# EasyEDA Pro project kuafu01_030内部老化方案.eprj, board PCB4 (continued)
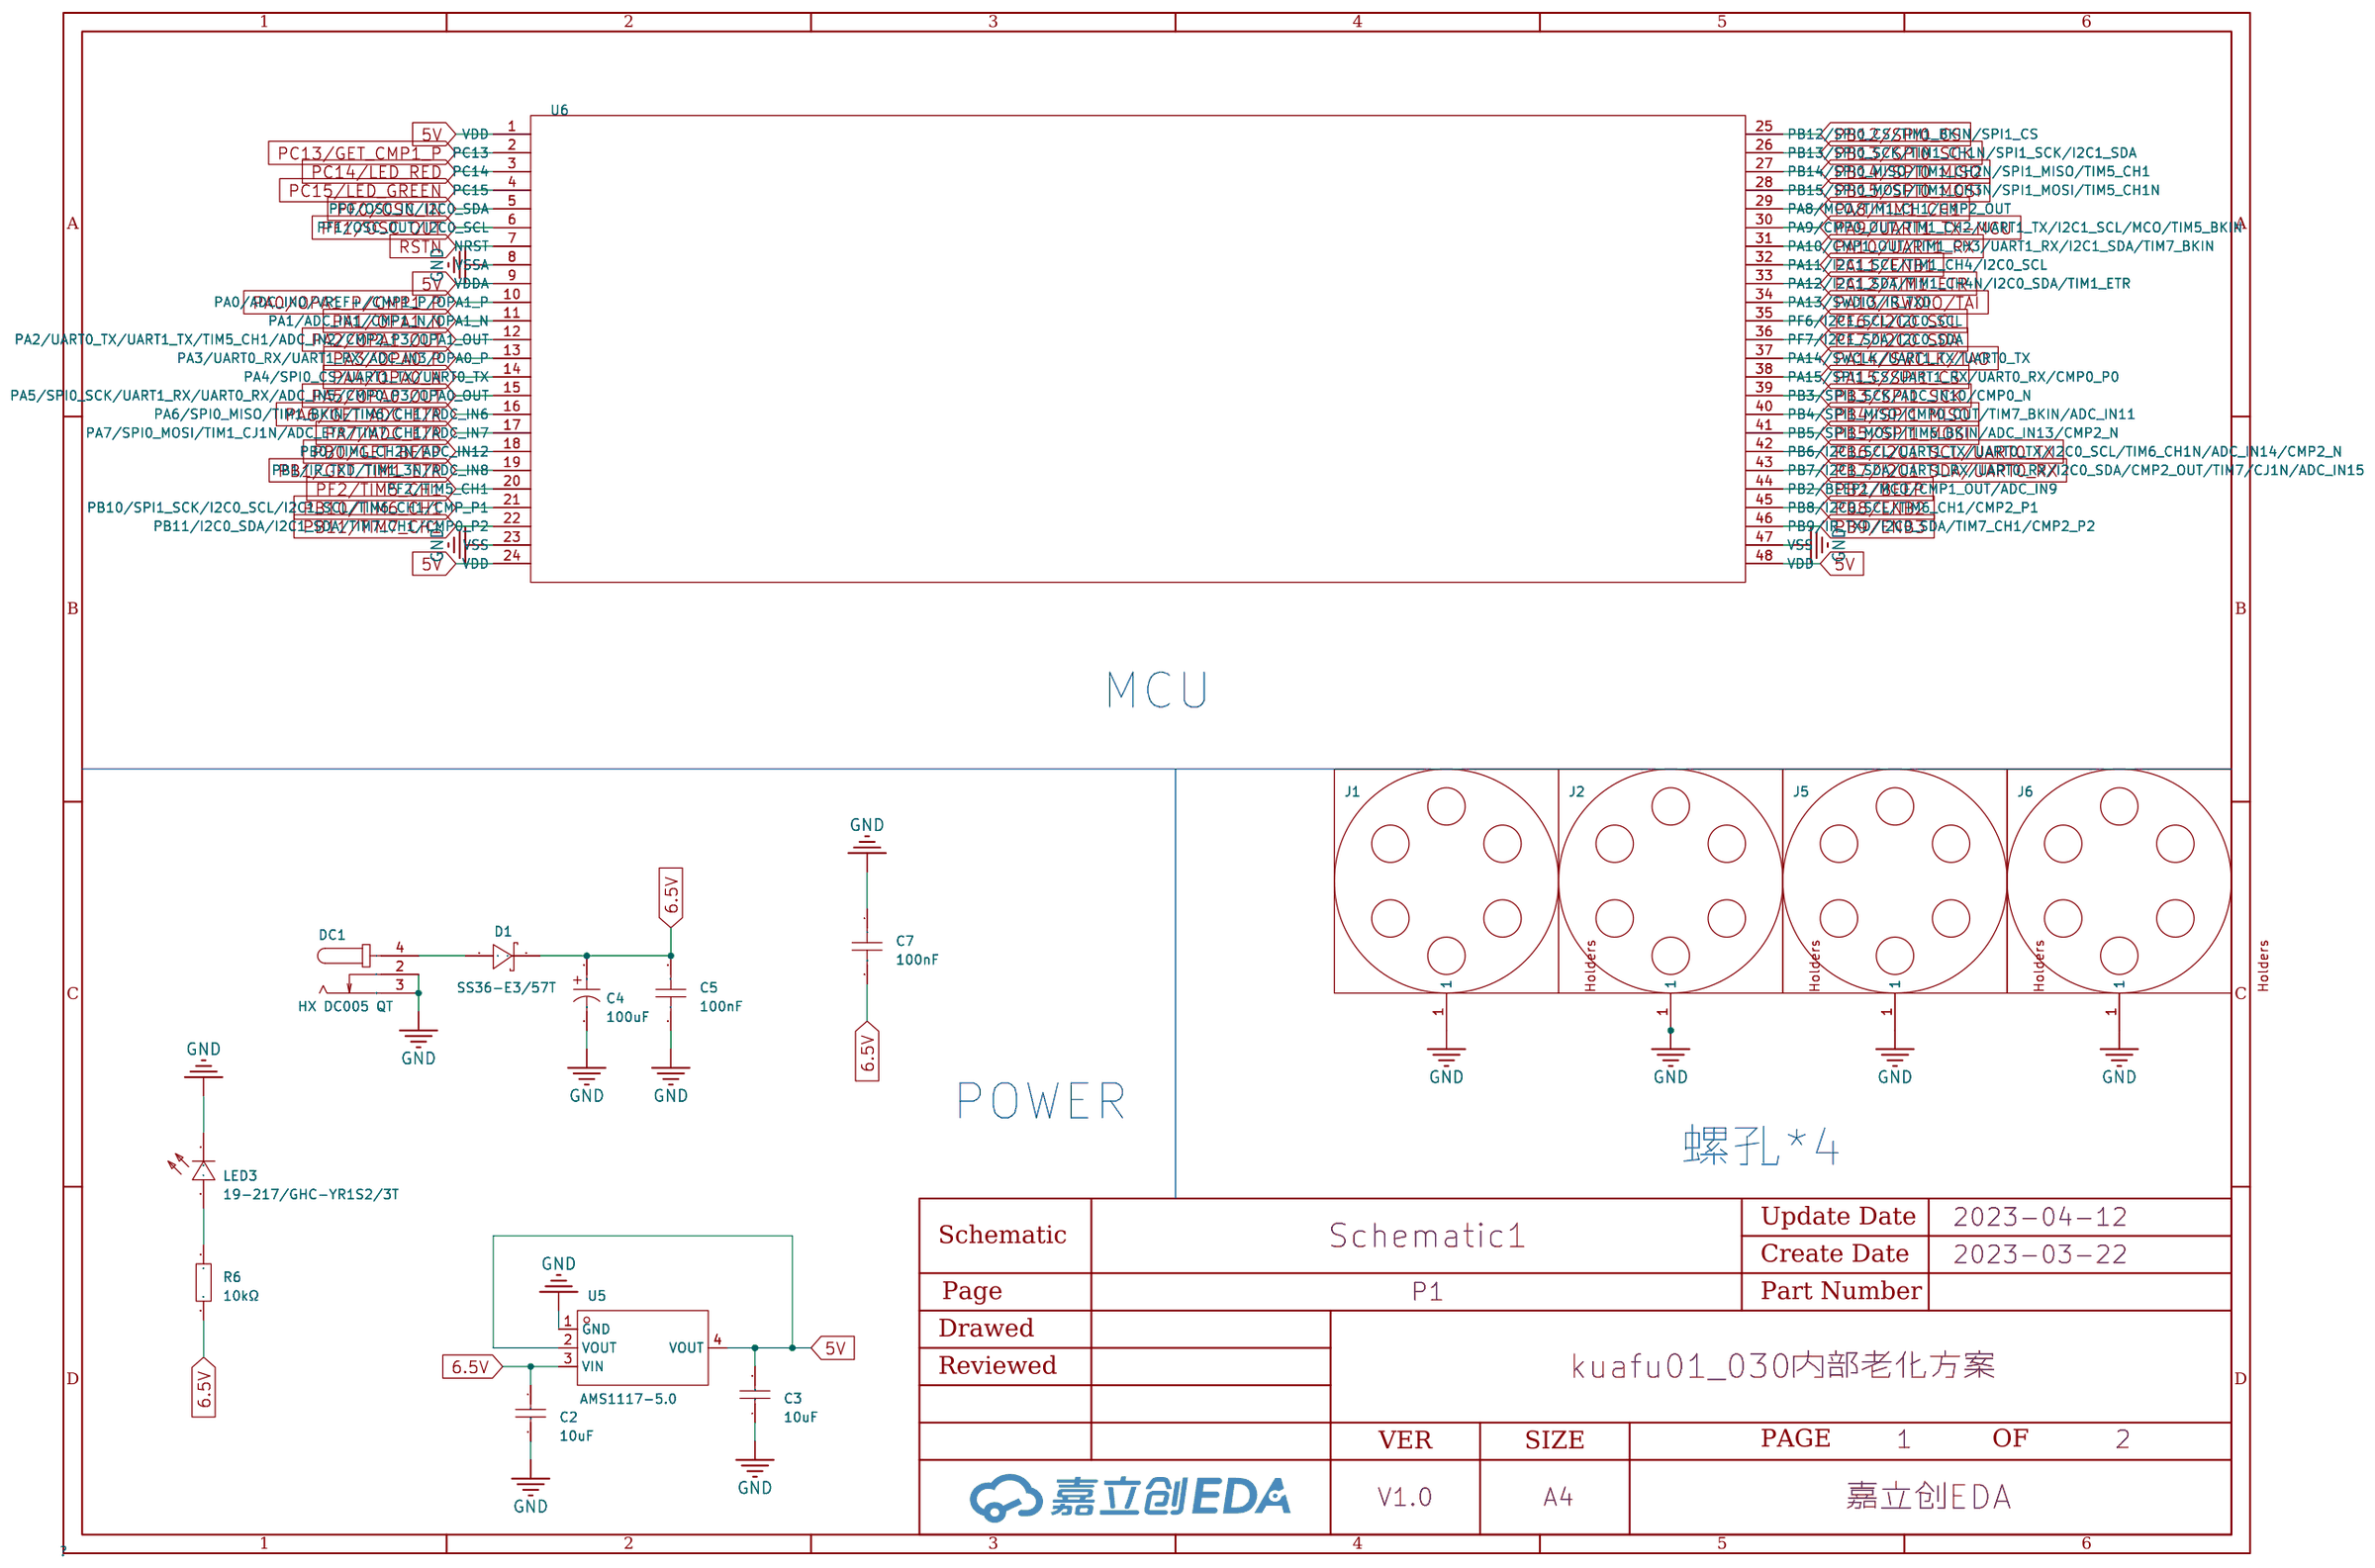
[diagram p0: P1]
## Routing (per net, layer and track width the routed paths; a pad name or vN(x,y) marks a point on that pad's centre or on a via; arc(x,y) is an arc through that point) (continued)
  Bottom Layer w0.508: v1(84.88,172.7) 84.84,172.7 84.04,173.5 v1(84.04,175.27) ; v1(41.35,80.87) 40.1,79.62 v1(40.1,78.72) 40.1,77.97 37.73,75.6 ; v1(185.64,327.67) 185.64,325.9 186.44,325.1 v1(186.48,325.1) ; v1(94.69,29.11) 94.69,29.13 98.79,33.23 98.81,33.23 v1(99.76,32.29) ; v1(196.29,181.51) 196.29,181.53 200.39,185.63 200.41,185.63 v1(201.36,184.69) ; 240.93,228 243.3,230.37 v1(243.3,231.12) 243.3,232.02 v1(244.55,233.27) ; v1(47.75,118.18) 47.77,118.2 61.27,118.2 62.56,119.49 v1(62.56,132.13) ; 206.29,219.88 v1(206.29,223.48) ; v1(145.49,130.71) 145.49,130.73 149.59,134.83 149.61,134.83 v1(150.56,133.89) ; v1(47.75,168.98) 47.77,169 61.27,169 62.56,170.29 v1(62.56,182.93) ; v1(305.59,250.36) 305.58,250.35 304.06,250.35 v1(302.13,248.43) ; 103.66,363.73 83.31,363.73 81.28,361.7 v1(81.28,359.16) 81.28,353.86 v1(75.22,347.8) ; 103.66,363.73 103.69,363.7 v1(103.69,358.21) ; 103.66,363.73 154.52,363.73 ; v1(84.04,226.07) 84.04,224.3 84.84,223.5 v1(84.88,223.5) ; 52.89,57.4 v1(52.89,53.41) ; 52.89,57.4 103.69,57.4 ; 52.89,57.4 24.89,57.4 22.86,59.44 22.86,103.63 27.94,108.71 52.89,108.71 ; v1(33.24,22.87) 33.24,21.1 34.04,20.3 v1(34.08,20.3) ; v1(147.29,347.49) 147.24,347.54 ; v1(254.79,250.36) 254.78,250.35 253.26,250.35 v1(251.34,248.43) ; v1(84.04,73.67) 84.04,71.9 84.84,71.1 v1(84.88,71.1) ; v1(48.96,32.29) 48.01,33.23 47.99,33.23 43.89,29.13 v1(43.89,29.11) ; v1(102.39,351.96) 102.38,351.95 100.86,351.95 v1(98.94,350.03) ; v1(205.29,307.41) 205.29,311.89 205.26,311.91 ; 205.29,159 v1(205.29,155.01) ; 205.29,159 154.49,159 ; 205.29,159 256.09,159 ; 88.53,24.8 90.9,27.17 v1(90.9,27.92) 90.9,28.82 v1(92.15,30.07) ; v1(134.84,73.67) 134.84,71.9 135.64,71.1 v1(135.68,71.1) ; v1(98.94,45.23) 100.86,47.15 102.38,47.15 v1(102.39,47.16) ; v1(299.69,144.29) 299.64,144.34 ; v1(96.49,195.09) 96.44,195.14 ; 154.49,159 v1(154.49,155.01) ; 154.49,159 52.89,159 ; v1(147.29,245.89) 147.24,245.94 ; v1(288.08,121.9) 288.04,121.9 287.24,122.7 v1(287.24,124.47) ; v1(150.56,235.49) 149.61,236.43 149.59,236.43 145.49,232.33 v1(145.49,232.31) ; v1(41.35,233.27) 40.1,232.02 v1(40.1,231.12) 40.1,230.37 37.73,228 ; v1(149.74,350.03) 151.66,351.95 153.18,351.95 v1(153.19,351.96) ; 53.89,169.08 v1(53.89,172.69) ; v1(295.35,182.47) 294.1,181.22 v1(294.1,180.32) 294.1,179.57 291.73,177.2 ; v1(251.34,299.23) 253.26,301.15 254.78,301.15 v1(254.79,301.16) ; v1(244.55,80.87) 243.3,79.62 v1(243.3,78.72) 243.3,77.97 240.93,75.6 ; v1(299.69,296.69) 299.64,296.74 ; v1(52.89,307.41) 52.89,311.9 52.87,311.91 ; 306.89,159 256.09,159 ; 306.89,159 v1(306.89,155.01) ; 306.89,159 327.15,159 330.71,155.45 330.71,111.25 328.17,108.71 306.89,108.71 ; 256.09,159 v1(256.09,155.01) ; 104.69,16.69 v1(104.69,20.28) ; v1(134.84,124.47) 134.84,122.7 135.64,121.9 v1(135.68,121.9) ; v1(248.89,195.09) 248.84,195.14 ; v1(265.76,284.53) 265.76,271.89 264.47,270.6 250.97,270.6 v1(250.95,270.58) ; v1(198.09,93.49) 198.04,93.54 ; v1(164.16,284.53) 164.16,271.89 162.87,270.6 149.37,270.6 v1(149.35,270.58) ; 139.33,228 141.7,230.37 v1(141.7,231.12) 141.7,232.02 v1(142.95,233.27) ; 206.29,169.08 v1(206.29,172.69) ; v1(186.48,71.1) 186.44,71.1 185.64,71.9 v1(185.64,73.67) ; v1(244.55,131.67) 243.3,130.42 v1(243.3,129.52) 243.3,128.77 240.93,126.4 ; v1(33.24,226.07) 33.24,224.3 34.04,223.5 v1(34.08,223.5) ; v1(45.69,93.49) 45.64,93.54 ; v1(96.49,144.29) 96.44,144.34 ; v1(185.64,226.07) 185.64,224.3 186.44,223.5 v1(186.48,223.5) ; v1(254.79,47.16) 254.78,47.15 253.26,47.15 v1(251.34,45.23) ; v1(200.15,321.38) 200.17,321.4 213.67,321.4 214.96,322.69 v1(214.96,335.33) ; 53.89,67.48 v1(53.89,71.08) ; v1(297.89,181.51) 297.89,181.53 301.99,185.63 302.01,185.63 v1(302.96,184.69) ; v1(153.19,97.96) 153.18,97.95 151.66,97.95 v1(149.74,96.03) ; 306.86,363.73 306.89,363.71 v1(306.89,358.21) ; 306.86,363.73 205.25,363.73 ; 306.86,363.73 329.18,363.73 332.74,360.17 332.74,318.01 326.64,311.91 306.86,311.91 ; 154.49,210.31 v1(154.49,205.81) ; 154.49,210.31 205.29,210.31 ; 154.49,210.31 103.69,210.31 ; 257.09,118.28 v1(257.09,121.88) ; v1(94.69,79.91) 94.69,79.93 98.79,84.03 98.81,84.03 v1(99.76,83.09) ; 257.09,270.69 v1(257.09,274.28) ; 306.89,210.31 v1(306.89,205.81) ; 306.89,210.31 326.14,210.31 330.2,214.38 330.2,258.06 327.15,261.11 306.89,261.11 ; 306.89,210.31 256.09,210.31 ; v1(98.55,321.38) 98.57,321.4 112.07,321.4 113.36,322.69 v1(113.36,335.33) ; 205.29,57.4 254.51,57.4 256.09,55.83 v1(256.09,53.41) ; 205.29,57.4 154.49,57.4 ; 205.29,57.4 v1(205.29,53.41) ; v1(134.84,327.67) 134.84,325.9 135.64,325.1 v1(135.68,325.1) ; v1(135.68,223.5) 135.64,223.5 134.84,224.3 v1(134.84,226.07) ; v1(196.29,333.91) 196.29,333.93 200.39,338.03 200.41,338.03 v1(201.36,337.09) ; v1(43.89,79.91) 43.89,79.93 47.99,84.03 48.01,84.03 v1(48.96,83.09) ; v1(251.34,146.83) 253.26,148.75 254.78,148.75 v1(254.79,148.76) ; v1(48.13,96.03) 50.06,97.95 51.58,97.95 v1(51.59,97.96) ; v1(200.15,270.58) 200.17,270.6 213.67,270.6 214.96,271.89 v1(214.96,284.53) ; v1(200.15,67.38) 200.17,67.4 213.67,67.4 214.96,68.69 v1(214.96,81.33) ; 205.29,210.31 v1(205.29,205.81) ; 205.29,210.31 256.09,210.31 ; 154.48,311.91 154.49,311.9 v1(154.49,307.41) ; 154.48,311.91 103.7,311.91 ; 154.48,311.91 205.26,311.91 ; v1(48.13,197.63) 50.06,199.55 51.58,199.55 v1(51.59,199.56) ; 257.09,219.88 v1(257.09,223.48) ; v1(92.15,233.27) 90.9,232.02 v1(90.9,231.12) 90.9,230.37 88.53,228 ; 103.69,57.4 154.49,57.4 ; 103.69,57.4 v1(103.69,53.41) ; 154.49,57.4 v1(154.49,53.41) ; 155.49,169.08 v1(155.49,172.69) ; v1(96.49,347.49) 96.44,347.54 ; v1(193.75,334.87) 192.5,333.62 v1(192.5,332.72) 192.5,331.97 190.13,329.6 ; v1(236.44,175.27) 236.44,173.5 237.24,172.7 v1(237.28,172.7) ; v1(200.53,248.43) 202.46,250.35 203.98,250.35 v1(203.99,250.36) ; v1(98.94,96.03) 100.86,97.95 102.38,97.95 v1(102.39,97.96) ; 206.29,118.28 v1(206.29,121.88) ; v1(302.96,133.89) 302.01,134.83 301.99,134.83 297.89,130.73 v1(297.89,130.71) ; 139.33,278.8 141.7,281.17 v1(141.7,281.92) 141.7,282.82 v1(142.95,284.07) ; v1(103.69,256.61) 103.69,261.08 103.66,261.11 ; v1(142.95,80.87) 141.7,79.62 v1(141.7,78.72) 141.7,77.97 139.33,75.6 ; 52.86,261.11 22.86,261.11 20.32,263.65 20.32,309.37 22.86,311.91 52.87,311.91 ; 52.86,261.11 103.66,261.11 ; 52.86,261.11 52.89,261.09 v1(52.89,256.61) ; 139.33,329.6 141.7,331.97 v1(141.7,332.72) 141.7,333.62 v1(142.95,334.87) ; v1(200.15,118.18) 200.17,118.2 213.67,118.2 214.96,119.49 v1(214.96,132.13) ; v1(248.89,144.29) 248.84,144.34 ; v1(252.16,83.09) 251.21,84.03 251.19,84.03 247.09,79.93 v1(247.09,79.91) ; v1(306.89,307.41) 306.89,311.89 306.86,311.91 ; v1(248.89,296.69) 248.84,296.74 ; v1(250.95,67.38) 250.97,67.4 264.47,67.4 265.76,68.69 v1(265.76,81.33) ; 291.73,228 294.1,230.37 v1(294.1,231.12) 294.1,232.02 v1(295.35,233.27) ; v1(164.16,335.33) 164.16,322.69 162.87,321.4 149.37,321.4 v1(149.35,321.38) ; v1(288.08,71.1) 288.04,71.1 287.24,71.9 v1(287.24,73.67) ; v1(198.09,347.49) 198.04,347.54 ; v1(92.15,182.47) 90.9,181.22 v1(90.9,180.32) 90.9,179.57 88.53,177.2 ; v1(98.55,168.98) 98.57,169 112.07,169 113.36,170.29 v1(113.36,182.93) ; v1(196.29,130.71) 196.29,130.73 200.39,134.83 200.41,134.83 v1(201.36,133.89) ; 256.09,261.11 205.29,261.11 ; 256.09,261.11 306.89,261.11 ; 256.09,261.11 v1(256.09,256.61) ; 205.29,261.11 154.45,261.11 ; 205.29,261.11 v1(205.29,256.61) ; v1(153.19,250.36) 153.18,250.35 151.66,250.35 v1(149.74,248.43) ; 206.29,321.49 v1(206.29,325.08) ; v1(41.35,131.67) 40.1,130.42 v1(40.1,129.52) 40.1,128.77 37.73,126.4 ; v1(84.88,121.9) 84.84,121.9 84.04,122.7 v1(84.04,124.47) ; 190.13,126.4 192.5,128.77 v1(192.5,129.52) 192.5,130.42 v1(193.75,131.67) ; v1(193.75,80.87) 192.5,79.62 v1(192.5,78.72) 192.5,77.97 190.13,75.6 ; v1(134.84,175.27) 134.84,173.5 135.64,172.7 v1(135.68,172.7) ; 257.09,16.69 v1(257.09,20.28) ; v1(193.75,233.27) 192.5,232.02 v1(192.5,231.12) 192.5,230.37 190.13,228 ; v1(98.94,248.43) 100.86,250.35 102.38,250.35 v1(102.39,250.36) ; v1(153.19,301.16) 153.18,301.15 151.66,301.15 v1(149.74,299.23) ; v1(302.96,286.29) 302.01,287.23 301.99,287.23 297.89,283.13 v1(297.89,283.11) ; v1(84.88,325.1) 84.84,325.1 84.04,325.9 v1(84.04,327.67) ; v1(185.64,175.27) 185.64,173.5 186.44,172.7 v1(186.48,172.7) ; v1(135.68,274.3) 135.64,274.3 134.84,275.1 v1(134.84,276.87) ; 240.93,278.8 243.3,281.17 v1(243.3,281.92) 243.3,282.82 v1(244.55,284.07) ; v1(98.55,118.18) 98.57,118.2 112.07,118.2 113.36,119.49 v1(113.36,132.13) ; v1(96.49,42.69) 96.44,42.74 ; v1(196.29,79.91) 196.29,79.93 200.39,84.03 200.41,84.03 v1(201.36,83.09) ; v1(302.13,299.23) 304.06,301.15 305.58,301.15 v1(305.59,301.16) ; v1(214.96,233.73) 214.96,221.09 213.67,219.8 200.17,219.8 v1(200.15,219.78) ; v1(288.08,172.7) 288.04,172.7 287.24,173.5 v1(287.24,175.27) ; v1(48.96,184.69) 48.01,185.63 47.99,185.63 43.89,181.53 v1(43.89,181.51) ; v1(200.53,299.23) 202.46,301.15 203.98,301.15 v1(203.99,301.16) ; 154.52,363.73 154.49,363.69 v1(154.49,358.21) ; 154.52,363.73 205.25,363.73 ; 240.93,177.2 243.3,179.57 v1(243.3,180.32) 243.3,181.22 v1(244.55,182.47) ; v1(265.76,132.13) 265.76,119.49 264.47,118.2 250.97,118.2 v1(250.95,118.18) ; v1(198.09,296.69) 198.04,296.74 ; v1(247.09,181.51) 247.09,181.53 251.19,185.63 251.21,185.63 v1(252.16,184.69) ; v1(98.55,67.38) 98.57,67.4 112.07,67.4 113.36,68.69 v1(113.36,81.33) ; v1(142.95,30.07) 141.7,28.82 v1(141.7,27.92) 141.7,27.17 139.33,24.8 ; 53.89,16.69 v1(53.89,20.28) ; v1(193.75,284.07) 192.5,282.82 v1(192.5,281.92) 192.5,281.17 190.13,278.8 ; v1(316.56,335.33) 316.56,322.69 315.27,321.4 301.77,321.4 v1(301.75,321.38) ; v1(48.13,299.23) 50.06,301.15 51.58,301.15 v1(51.59,301.16) ; v1(102.39,301.16) 102.38,301.15 100.86,301.15 v1(98.94,299.23) ; v1(301.75,67.38) 301.77,67.4 315.27,67.4 316.56,68.69 v1(316.56,81.33) ; 240.93,24.8 243.3,27.17 v1(243.3,27.92) 243.3,28.82 v1(244.55,30.07) ; v1(236.44,327.67) 236.44,325.9 237.24,325.1 v1(237.28,325.1) ; v1(51.59,47.16) 51.58,47.15 50.06,47.15 v1(48.13,45.23) ; v1(149.74,45.23) 151.66,47.15 153.18,47.15 v1(153.19,47.16) ; 306.89,261.11 v1(306.89,256.61) ; v1(301.75,270.58) 301.77,270.6 315.27,270.6 316.56,271.89 v1(316.56,284.53) ; v1(302.96,337.09) 302.01,338.03 301.99,338.03 297.89,333.93 v1(297.89,333.91) ; v1(256.09,307.41) 256.09,311.91 256.08,311.91 ; 307.89,169.08 v1(307.89,172.69) ; v1(244.55,334.87) 243.3,333.62 v1(243.3,332.72) 243.3,331.97 240.93,329.6 ; 307.89,270.69 v1(307.89,274.28) ; 103.66,261.11 154.45,261.11 ; v1(45.69,195.09) 45.64,195.14 ; v1(254.79,351.96) 254.78,351.95 253.26,351.95 v1(251.34,350.03) ; v1(33.24,124.47) 33.24,122.7 34.04,121.9 v1(34.08,121.9) ; 190.13,24.8 192.5,27.17 v1(192.5,27.92) 192.5,28.82 v1(193.75,30.07) ; v1(295.35,334.87) 294.1,333.62 v1(294.1,332.72) 294.1,331.97 291.73,329.6 ; v1(186.48,20.3) 186.44,20.3 185.64,21.1 v1(185.64,22.87) ; v1(94.69,181.51) 94.69,181.53 98.79,185.63 98.81,185.63 v1(99.76,184.69) ; v1(43.89,283.11) 43.89,283.13 47.99,287.23 48.01,287.23 v1(48.96,286.29) ; v1(196.29,29.11) 196.29,29.13 200.39,33.23 200.41,33.23 v1(201.36,32.29) ; v1(147.29,296.69) 147.24,296.74 ; 205.26,311.91 256.08,311.91 ; 257.09,67.48 v1(257.09,71.08) ; v1(149.35,219.78) 149.37,219.8 162.87,219.8 164.16,221.09 v1(164.16,233.73) ; v1(302.96,83.09) 302.01,84.03 301.99,84.03 297.89,79.93 v1(297.89,79.91) ; v1(203.99,47.16) 203.98,47.15 202.46,47.15 v1(200.53,45.23) ; v1(145.49,283.11) 145.49,283.13 149.59,287.23 149.61,287.23 v1(150.56,286.29) ; v1(305.59,148.76) 305.58,148.75 304.06,148.75 v1(302.13,146.83) ; 155.49,67.48 v1(155.49,71.08) ; 256.09,108.71 205.29,108.71 ; 256.09,108.71 v1(256.09,104.21) ; 256.09,108.71 306.89,108.71 ; 205.29,108.71 154.49,108.71 ; 205.29,108.71 v1(205.29,104.21) ; v1(99.76,337.09) 98.81,338.03 98.79,338.03 94.69,333.93 v1(94.69,333.91) ; v1(236.44,22.87) 236.44,21.1 237.24,20.3 v1(237.28,20.3) ; 37.73,177.2 40.1,179.57 v1(40.1,180.32) 40.1,181.22 v1(41.35,182.47) ; v1(200.53,96.03) 202.46,97.95 203.98,97.95 v1(203.99,97.96) ; v1(200.15,16.58) 200.17,16.6 213.67,16.6 214.96,17.89 v1(214.96,30.53) ; 306.86,311.91 256.08,311.91 ; v1(196.29,232.31) 196.29,232.33 200.39,236.43 200.41,236.43 v1(201.36,235.49) ; 52.89,210.31 27.43,210.31 24.89,207.77 24.89,160.53 26.42,159 52.89,159 ; 52.89,210.31 v1(52.89,205.81) ; 52.89,210.31 103.69,210.31 ; v1(48.13,248.43) 50.06,250.35 51.58,250.35 v1(51.59,250.36) ; v1(252.16,133.89) 251.21,134.83 251.19,134.83 247.09,130.73 v1(247.09,130.71) ; v1(48.96,133.89) 48.01,134.83 47.99,134.83 43.89,130.73 v1(43.89,130.71) ; v1(153.19,148.76) 153.18,148.75 151.66,148.75 v1(149.74,146.83) ; v1(84.88,20.3) 84.84,20.3 84.04,21.1 v1(84.04,22.87) ; 154.45,261.11 154.49,261.08 v1(154.49,256.61) ; v1(205.29,358.21) 205.29,363.69 205.25,363.73 ; v1(295.35,284.07) 294.1,282.82 v1(294.1,281.92) 294.1,281.17 291.73,278.8 ; v1(252.16,32.29) 251.21,33.23 251.19,33.23 247.09,29.13 v1(247.09,29.11) ; v1(186.48,274.3) 186.44,274.3 185.64,275.1 v1(185.64,276.87) ; v1(99.76,133.89) 98.81,134.83 98.79,134.83 94.69,130.73 v1(94.69,130.71) ; v1(45.69,296.69) 45.64,296.74 ; v1(198.09,144.29) 198.04,144.34 ; v1(92.15,80.87) 90.9,79.62 v1(90.9,78.72) 90.9,77.97 88.53,75.6 ; v1(47.75,16.58) 47.77,16.6 61.27,16.6 62.56,17.89 v1(62.56,30.53) ; v1(135.68,20.3) 135.64,20.3 134.84,21.1 v1(134.84,22.87) ; v1(47.75,67.38) 47.77,67.4 61.27,67.4 62.56,68.69 v1(62.56,81.33) ; v1(43.89,232.31) 43.89,232.33 47.99,236.43 48.01,236.43 v1(48.96,235.49) ; v1(237.28,274.3) 237.24,274.3 236.44,275.1 v1(236.44,276.87) ; 104.69,67.48 v1(104.69,71.08) ; v1(265.76,335.33) 265.76,322.69 264.47,321.4 250.97,321.4 v1(250.95,321.38) ; v1(302.13,96.03) 304.06,97.95 305.58,97.95 v1(305.59,97.96) ; v1(96.49,296.69) 96.44,296.74 ; 154.49,108.71 103.69,108.71 ; 154.49,108.71 v1(154.49,104.21) ; v1(316.56,233.73) 316.56,221.09 315.27,219.8 301.77,219.8 v1(301.75,219.78) ; v1(301.75,168.98) 301.77,169 315.27,169 316.56,170.29 v1(316.56,182.93) ; v1(236.44,73.67) 236.44,71.9 237.24,71.1 v1(237.28,71.1) ; v1(164.16,81.33) 164.16,68.69 162.87,67.4 149.37,67.4 v1(149.35,67.38) ; v1(34.08,274.3) 34.04,274.3 33.24,275.1 v1(33.24,276.87) ; v1(102.39,199.56) 102.38,199.55 100.86,199.55 v1(98.94,197.63) ; v1(248.89,245.89) 248.84,245.94 ; v1(103.69,307.41) 103.69,311.89 103.7,311.91 ; 37.73,278.8 40.1,281.17 v1(40.1,281.92) 40.1,282.82 v1(41.35,284.07) ; v1(142.95,182.47) 141.7,181.22 v1(141.7,180.32) 141.7,179.57 139.33,177.2 ; v1(164.16,30.53) 164.16,17.89 162.87,16.6 149.37,16.6 v1(149.35,16.58) ; v1(149.35,118.18) 149.37,118.2 162.87,118.2 164.16,119.49 v1(164.16,132.13) ; v1(92.15,131.67) 90.9,130.42 v1(90.9,129.52) 90.9,128.77 88.53,126.4 ; v1(51.59,148.76) 51.58,148.75 50.06,148.75 v1(48.13,146.83) ; v1(299.69,245.89) 299.64,245.94 ; v1(147.29,195.09) 147.24,195.14 ; v1(50.33,319.86) v1(47.79,319.86) ; v1(201.36,286.29) 200.41,287.23 200.39,287.23 196.29,283.13 v1(196.29,283.11) ; v1(265.76,30.53) 265.76,17.89 264.47,16.6 250.97,16.6 v1(250.95,16.58) ; v1(185.64,124.47) 185.64,122.7 186.44,121.9 v1(186.48,121.9) ; 52.89,108.71 103.69,108.71 ; 52.89,108.71 v1(52.89,104.21) ; v1(247.09,232.31) 247.09,232.33 251.19,236.43 251.21,236.43 v1(252.16,235.49) ; v1(248.89,42.69) 248.84,42.74 ; v1(45.69,42.69) 45.64,42.74 ; v1(316.56,132.13) 316.56,119.49 315.27,118.2 301.77,118.2 v1(301.75,118.18) ; v1(203.99,148.76) 203.98,148.75 202.46,148.75 v1(200.53,146.83) ; v1(248.89,347.49) 248.84,347.54 ; v1(113.36,30.53) 113.36,17.89 112.07,16.6 98.57,16.6 v1(98.55,16.58) ; v1(265.76,233.73) 265.76,221.09 264.47,219.8 250.97,219.8 v1(250.95,219.78) ; v1(113.36,233.73) 113.36,221.09 112.07,219.8 98.57,219.8 v1(98.55,219.78) ; 256.09,210.31 v1(256.09,205.81) ; v1(150.56,83.09) 149.61,84.03 149.59,84.03 145.49,79.93 v1(145.49,79.91) ; v1(94.69,232.31) 94.69,232.33 98.79,236.43 98.81,236.43 v1(99.76,235.49) ; v1(200.53,197.63) 202.46,199.55 203.98,199.55 v1(203.99,199.56) ; v1(149.74,197.63) 151.66,199.55 153.18,199.55 v1(153.19,199.56) ; v1(302.13,197.63) 304.06,199.55 305.58,199.55 v1(305.59,199.56) ; v1(34.08,71.1) 34.04,71.1 33.24,71.9 v1(33.24,73.67) ; v1(198.09,42.69) 198.04,42.74 ; 52.87,311.91 103.7,311.91 ; 190.13,177.2 192.5,179.57 v1(192.5,180.32) 192.5,181.22 v1(193.75,182.47) ; v1(237.28,223.5) 237.24,223.5 236.44,224.3 v1(236.44,226.07) ; v1(145.49,333.91) 145.49,333.93 149.59,338.03 149.61,338.03 v1(150.56,337.09) ; 103.69,108.71 v1(103.69,104.21) ; v1(251.34,96.03) 253.26,97.95 254.78,97.95 v1(254.79,97.96) ; 52.89,159 v1(52.89,155.01) ; v1(252.16,286.29) 251.21,287.23 251.19,287.23 247.09,283.13 v1(247.09,283.11) ; 155.49,118.28 v1(155.49,121.88) ; 104.69,219.88 v1(104.69,223.48) ; v1(92.15,334.87) 90.9,333.62 v1(90.9,332.72) 90.9,331.97 88.53,329.6 ; v1(287.24,327.67) 287.24,325.9 288.04,325.1 v1(288.08,325.1) ; 257.09,321.49 v1(257.09,325.08) ; v1(94.69,283.11) 94.69,283.13 98.79,287.23 98.81,287.23 v1(99.76,286.29) ; v1(84.88,274.3) 84.84,274.3 84.04,275.1 v1(84.04,276.87) ; v1(299.69,195.09) 299.64,195.14 ; v1(45.69,144.29) 45.64,144.34 ; 53.89,270.69 v1(53.89,274.28) ; 155.49,321.49 v1(155.49,325.08) ; v1(295.35,80.87) 294.1,79.62 v1(294.1,78.72) 294.1,77.97 291.73,75.6 ; v1(251.34,197.63) 253.26,199.55 254.78,199.55 v1(254.79,199.56) ; v1(265.76,182.93) 265.76,170.29 264.47,169 250.97,169 v1(250.95,168.98) ; 104.69,169.08 v1(104.69,172.69) ; v1(147.29,42.69) 147.24,42.74 ; 103.69,210.31 v1(103.69,205.81) ; v1(164.16,182.93) 164.16,170.29 162.87,169 149.37,169 v1(149.35,168.98) ; 307.89,219.88 v1(307.89,223.48) ; v1(41.35,30.07) 40.1,28.82 v1(40.1,27.92) 40.1,27.17 37.73,24.8 ; 155.49,219.88 v1(155.49,223.48) ; v1(299.69,93.49) 299.64,93.54 ; v1(33.24,175.27) 33.24,173.5 34.04,172.7 v1(34.08,172.7) ; 104.69,270.69 v1(104.69,274.28) ; 139.33,126.4 141.7,128.77 v1(141.7,129.52) 141.7,130.42 v1(142.95,131.67) ; v1(145.49,29.11) 145.49,29.13 149.59,33.23 149.61,33.23 v1(150.56,32.29) ; v1(62.56,233.73) 62.56,221.09 61.27,219.8 47.77,219.8 v1(47.75,219.78) ; v1(200.53,350.03) 202.46,351.95 203.98,351.95 v1(203.99,351.96) ; v1(98.94,146.83) 100.86,148.75 102.38,148.75 v1(102.39,148.76) ; 306.89,108.71 v1(306.89,104.21) ; 206.29,270.69 v1(206.29,274.28) ; v1(287.24,276.87) 287.24,275.1 288.04,274.3 v1(288.08,274.3) ; 155.49,270.69 v1(155.49,274.28) ; v1(147.29,93.49) 147.24,93.54 ; 307.89,118.28 v1(307.89,121.88) ; v1(198.09,195.09) 198.04,195.14 ; 206.29,16.69 v1(206.29,20.28) ; 104.69,321.49 v1(104.69,325.08) ; v1(150.56,184.69) 149.61,185.63 149.59,185.63 145.49,181.53 v1(145.49,181.51) ; v1(299.69,347.49) 299.64,347.54 ; v1(248.89,93.49) 248.84,93.54 ; v1(287.24,226.07) 287.24,224.3 288.04,223.5 v1(288.08,223.5) ; 53.89,118.28 v1(53.89,121.88) ; v1(96.49,93.49) 96.44,93.54 ; 53.89,219.88 v1(53.89,223.48) ; v1(147.29,144.29) 147.24,144.34 ; v1(236.44,124.47) 236.44,122.7 237.24,121.9 v1(237.28,121.9) ; v1(113.36,284.53) 113.36,271.89 112.07,270.6 98.57,270.6 v1(98.55,270.58) ; v1(295.35,131.67) 294.1,130.42 v1(294.1,129.52) 294.1,128.77 291.73,126.4 ; v1(302.96,235.49) 302.01,236.43 301.99,236.43 297.89,232.33 v1(297.89,232.31) ; v1(62.56,284.53) 62.56,271.89 61.27,270.6 47.77,270.6 v1(47.75,270.58) ; v1(247.09,333.91) 247.09,333.93 251.19,338.03 251.21,338.03 v1(252.16,337.09) ; v1(66.08,319.86) v1(63.54,319.86) ; v1(103.69,155.01) 103.69,159 ; v1(200.15,168.98) 200.17,169 213.67,169 214.96,170.29 v1(214.96,182.93) ; v1(302.13,350.03) 304.06,351.95 305.58,351.95 v1(305.59,351.96) ; v1(198.09,245.89) 198.04,245.94 ; 307.89,67.48 v1(307.89,71.08) ; 307.89,321.49 v1(307.89,325.08) ; 206.29,67.48 v1(206.29,71.08) ; 104.69,118.28 v1(104.69,121.88) ; 155.49,16.69 v1(155.49,20.28) ; v1(45.69,245.89) 45.64,245.94 ; 88.53,278.8 90.9,281.17 v1(90.9,281.92) 90.9,282.82 v1(92.15,284.07) ; 257.09,169.08 v1(257.09,172.69) ; v1(96.49,245.89) 96.44,245.94